# EasyEDA Pro project AgOopenHardwareMicro.eprj, schematic AiO v4 Micro Robin (continued)
## Sheets (continued)
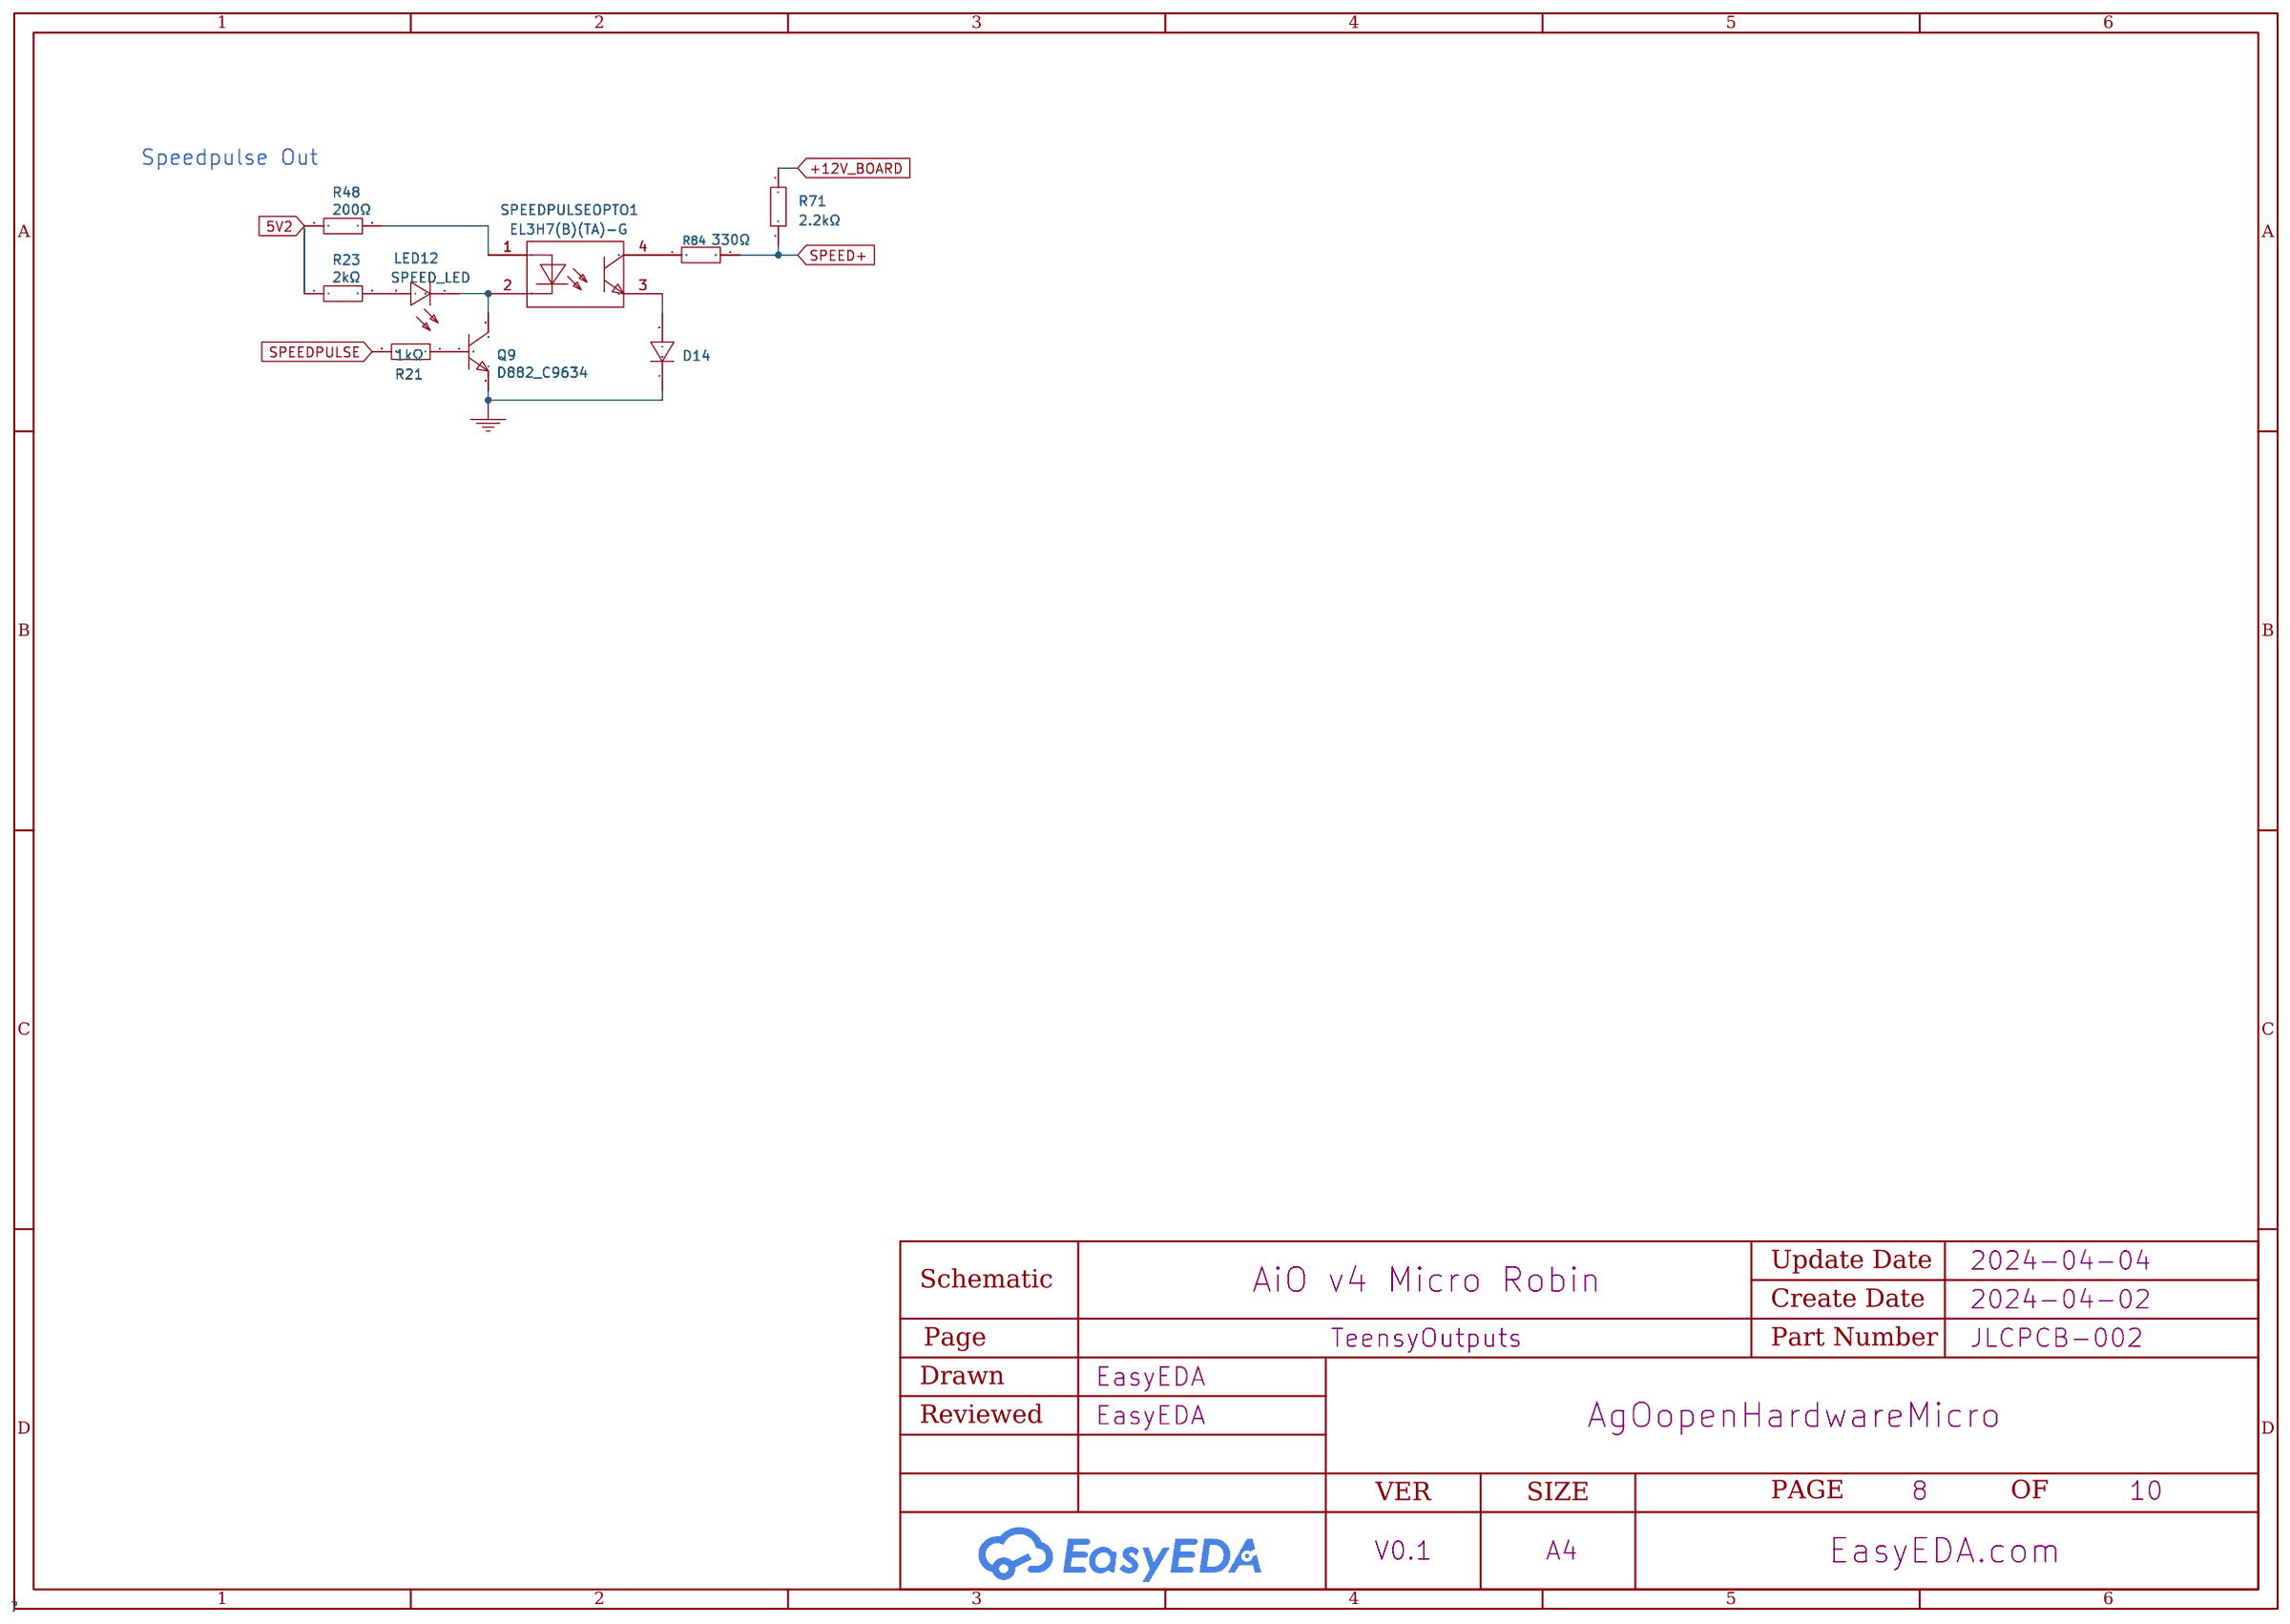
[diagram p9: TeensyOutputs]

## Parts
sheet GNSS
H1  HEADER_2mm  [footprint_0abc]
H7  HEADER_2mm  [footprint_0abc]
H9  HEADER_2mm_XBEE  [footprint_0abc]
H10  HEADER_2mm_XBEE  [footprint_0abc]
H11  HEADER_2mm  [footprint_0abc]
H12  HEADER_2mm  [footprint_0abc]
LED1  RTK_STAT_1  [footprint_1af2]  (no BOM)
LED2  RTK_STAT_2  [footprint_1af2]  (no BOM)
LED3  RTK  [footprint_6589]
LED5  RTK  [footprint_6589]
LED15  0603_RED  [footprint_985f]
LED16  0603_RED  [footprint_985f]
P2  RTK Radio  [footprint_4317]  (no BOM)
R6  1kΩ  [footprint_4e14]
R8  1k  [footprint_b4b1]  (no BOM)
R19  1kΩ  [footprint_4e14]
R26  1kΩ  [footprint_4e14]
R31  1k  [footprint_b4b1]  (no BOM)
R54  1kΩ  [footprint_4e14]
SJ2  PH2.54-01-03PZD  [HDR-TH_3P-P2.54-V-M]
U11  Dual-Left  [footprint_247a]  (no BOM)
U18  Single/Dual-Right  [footprint_3ab3]  (no BOM)
U21  LR_RADIO_XBEE_SOCKET  [footprint_2c55]  (no BOM)
USB2  MICRO 180°JB  [footprint_5333]
USB3  MICRO 180°JB  [footprint_5333]
sheet IMU
H13  HEADER_6PINS  [footprint_c888]
H14  HEADER_6PINS  [footprint_c888]
R12  2.2kΩ  [footprint_dc35]  (no BOM)
R13  2.2kΩ  [footprint_dc35]  (no BOM)
U15  Ardfruit BNO085  [footprint_7c61]  (no BOM)
sheet Power
C5  22uF  [footprint_a80e]  (no BOM)
C6  22uF  [footprint_a80e]  (no BOM)
C8  100uF  [footprint_7bcb]
C9  100uF  [footprint_7bcb]
C10  100uF  [footprint_7bcb]
C14  22uF  [footprint_a80e]  (no BOM)
C15  1000uF  [footprint_6613]
C17  1000uF  [footprint_6613]
CN3  DB128V-5.08-6P-GN-S  [CONN-TH_6P-P5.08_DIBO_DB128V-5.08]
D2  1N5401  [footprint_8dbb]  (no BOM)
D3  1N4004  [footprint_00b7]  (no BOM)
D6  SS54_C22452  [footprint_14cd]
D7  SM4007PL  [footprint_5765]
D13  SM4007PL  [footprint_5765]
FH1  178.6764.0001  [footprint_57e4]
H3  Ground  [footprint_dfc0]  (no BOM)
H24  5V  [footprint_dfc0]  (no BOM)
J3  3V3  [footprint_4a10]  (no BOM)
LED4  5V  [footprint_6589]
LED7  5V WAS  [footprint_6589]
LED8  3V3  [footprint_6589]
LED17  0603_RED  [footprint_985f]
R10  1kΩ  [footprint_4e14]
R17  5.1kΩ  [footprint_76e4]
R18  1kΩ  [footprint_4e14]
R61  5.1kΩ  [footprint_76e4]
U3  K7803M-1000R3  [footprint_a0e4]
U5  Teensy/IMU Power  [footprint_8be4]
U6  MC7805CTG  [footprint_f649]
U31  MTP125-1102S1  [HDR-TH_2P-P2.54-V-M-1]
sheet Teensy
C12  0.1uF  [footprint_9b0b]  (no BOM)
C26  100nF  [footprint_19ac]
CN2  A2005HWV-2X3P  [footprint_9724]
D20  1N5819WS  [footprint_5976]
D41  1N5819WS  [footprint_5976]
R24  1k  [footprint_b4b1]  (no BOM)
R42  1kΩ  [footprint_4e14]
RJ1  HR913550A  [footprint_28a5]
U20  TEENSY 4.1  [footprint_e0fd]  (no BOM)
U29  H_TEENSY  [footprint_5514]
U30  H_TEENSY  [footprint_5514]
U35-VUSB1  MTP125-1102S1  [HDR-TH_2P-P2.54-V-M-1]
sheet TeensyCAN
C11  100nF_CAN  [footprint_19ac]
D5  PESD1CAN,215  [footprint_eecc]
J2  MTP125-1102S1  [HDR-TH_2P-P2.54-V-M-1]
R64  120Ω  [footprint_dc35]
U17  MCP2562-E/SN  [footprint_ae0f]
U37  DB125-2.54-3P-GN-S  [CONN-TH_DB125-2.54-3P-GN]
sheet TeensyInputs
CN5  DB128V-5.08-4P-GN-S  [CONN-TH_4P-P5.08_DIBO_DB128V-5.08]
D4  SM4007PL  [footprint_5765]
D9  SM4007PL  [footprint_5765]
D11  SM4007PL  [footprint_5765]
D42  SM4007PL  [footprint_5765]
D43  SM4007PL  [footprint_5765]
D44  SM4007PL  [footprint_5765]
D45  SM4007PL  [footprint_5765]
H25  2.54-1*3P针  [HDR-TH_3P-P2.54-V-M-1]
LED_LIFTED_UP  Remote  [footprint_6b63]
LED_REMOTE1  Remote  [footprint_6b63]
LED_SPEED_GEAR  Remote  [footprint_6b63]
LED_SPEED_RADAR  Remote  [footprint_6b63]
LED_STEER1  Steer  [footprint_6b63]
LED_WORK1  Work  [footprint_6b63]
R1  270Ω  [footprint_eb8a]
R3  270Ω  [footprint_eb8a]
R16  270Ω  [footprint_eb8a]
R20  1kΩ  [footprint_4e14]
R52  1kΩ  [footprint_4e14]
R53  1kΩ  [footprint_4e14]
R76  1kΩ  [footprint_4e14]
R77  1kΩ  [footprint_4e14]
R78  1kΩ  [footprint_4e14]
R79  1kΩ  [footprint_4e14]
R80  1kΩ  [footprint_4e14]
R81  1kΩ  [footprint_4e14]
R82  1kΩ  [footprint_4e14]
R83  1kΩ  [footprint_4e14]
REMOTEOPTO1  EL3H7(B)(TA)-G  [footprint_7a44]
REMOTEOPTO2  EL3H7(B)(TA)-G  [footprint_7a44]
REMOTEOPTO3  EL3H7(B)(TA)-G  [footprint_7a44]
REMOTEOPTO4  EL3H7(B)(TA)-G  [footprint_7a44]
REMOTEOPTO5  EL3H7(B)(TA)-G  [footprint_7a44]
SPEED_PTO  Remote  [footprint_6b63]
STEEROPTO1  EL3H7(B)(TA)-G  [footprint_7a44]
WORKOPTO1  EL3H7(B)(TA)-G  [footprint_7a44]
X38  MX128-2.54-06P-GN01-Cu-Y-A  [CONN-TH_6P-P2.54_MX128-2.54-6P]
X39  MX128-2.54-06P-GN01-Cu-Y-A  [CONN-TH_6P-P2.54_MX128-2.54-6P]
sheet TeensyOutputs
D14  SM4007PL  [footprint_5765]
LED12  SPEED_LED  [footprint_985f]
Q9  D882_C9634  [footprint_acbf]
R21  1kΩ  [footprint_4e14]
R23  2kΩ  [footprint_4e14]
R48  200Ω  [footprint_dc35]
R71  2.2kΩ  [footprint_dc35]
R84  330Ω  [R0805]
SPEEDPULSEOPTO1  EL3H7(B)(TA)-G  [footprint_7a44]
sheet TeensyStatusLED
AS-ACT1  DY-339URUYGW/SN  [footprint_04ce]
GPS/RTK1  DY-339URUYGW/SN  [footprint_04ce]
LED9  PWM2_LED  [footprint_985f]
LED10  PWM1_LED  [footprint_985f]
LED11  DIR_LED  [footprint_985f]
PWR/ETH1  DY-339URUYGW/SN  [footprint_04ce]
R27  1kΩ  [footprint_4e14]
R28  1kΩ  [footprint_4e14]
R29  1kΩ  [footprint_4e14]
R30  1kΩ  [footprint_4e14]
R38  1kΩ  [footprint_4e14]
R39  1kΩ  [footprint_4e14]
R40  1kΩ  [footprint_4e14]
R41  1kΩ  [footprint_4e14]
R51  1kΩ  [footprint_4e14]
sheet WAS
C7  10nF  [footprint_89fb]
C16  100nF  [footprint_19ac]
C23  10nF  [footprint_89fb]
CN4  DB128V-5.08-4P-GN-S  [CONN-TH_4P-P5.08_DIBO_DB128V-5.08]
D16  1N5819WS  [footprint_5a89]
D17  1N5819WS  [footprint_5a89]
H26  2.54-1*3P针  [HDR-TH_3P-P2.54-V-M-1]
Q4  2N7002  [footprint_df55]
Q5  2N7002  [footprint_df55]
R22  5.1kΩ  [footprint_76e4]
R63  5.1kΩ  [footprint_76e4]
R73  1.5kΩ  [footprint_76e4]
R74  1.5kΩ  [footprint_76e4]
U4  ADS1115IDGSR  [footprint_a15c]

## Library data of the parts
H1 H7 H11 H12 = HEADER_2mm: Supplier: LCSC; Supplier Part: C691436; Manufacturer: BOOMELE(Boom Precision Elec); Manufacturer Part: C691436; JLCPCB Part Class: Extended Part
H9 H10 = HEADER_2mm_XBEE: Supplier: LCSC; Supplier Part: C691436; Manufacturer: BOOMELE(Boom Precision Elec); Manufacturer Part: C691436; JLCPCB Part Class: Extended Part
LED1 = RTK_STAT_1: Supplier: LCSC; Manufacturer: KENTO; Manufacturer Part: LEDOrange orange 3AO4UD; image: //image.lceda.cn/szlcsc/C62095.jpg; Supplier Part: C62095
LED2 = RTK_STAT_2: Supplier: LCSC; Manufacturer: KENTO; Manufacturer Part: LEDOrange orange 3AO4UD; image: //image.lceda.cn/szlcsc/C62095.jpg; Supplier Part: C62095
LED3 LED5 = RTK: Supplier: LCSC; Manufacturer: KENTO; Manufacturer Part: KT-0805翠绿; Supplier Part: C2297; JLCPCB Part Class: Basic Part
LED15-LED17 = 0603_RED: Supplier: LCSC; Manufacturer: null; Manufacturer Part: KT-0603R; Supplier Part: C2286; JLCPCB Part Class: Basic Part
P2 = RTK Radio: Supplier Part: C27542; Supplier: LCSC; Manufacturer: ReliaPro; Manufacturer Part: KF2510-4A; JLCPCB Part Class: Extended Part
R6 R10 R18-R21 R26-R30 R38-R42 R51-R54 R76-R83 = 1kΩ: Supplier: LCSC; Manufacturer: UNI-ROYAL(厚声); Manufacturer Part: 0603WAF1001T5E; Supplier Part: C21190; JLCPCB Part Class: Basic Part; link: https://lcsc.com/eda_search?q=C21190&amp;%26type=1&amp;ref=editor
R8 R24 R31 = 1k: Supplier: LCSC; Supplier Part: C433798; Manufacturer: TyoHM; Manufacturer Part: RD 1/2WS 1K J T/B A1
SJ2 = PH2.54-01-03PZD: Pin Structure:1x3P Pitch:2.54mm Circluar Pins/Square Pins:Square Pins Mounting Type:Straight Number of Rows:Plugin Number of Pins:3P Length of Mating Pin:6mm Insulation Height:2.5mm Length of End Connection Pin:3mm Contact Material: Operating Temperature; LCSC Part Name: 1x3P 间距:2.54mm 方针 直插; Supplier Part: C7501581; Manufacturer: XUNPU(讯普); Supplier Footprint: 插件,P=2.54mm; JLCPCB Part Class: Extended Part; Datasheet: https://atta.szlcsc.com/upload/public/pdf/source/20230815/30A24B1E4B9BDE2239C7F8E56770F33B.pdf; Supplier: LCSC; Pin Structure: 1x3P; Pitch: 2.54mm; Circluar Pins/Square Pins: Square Pins; Mounting Type: Straight; Number of Rows: Plugin; Number of Pins: 3P; Length of Mating Pin: 6mm; Insulation Height: 2.5mm; Length of End Connection Pin: 3mm; Operating Temperature Range: -40℃~+105℃; Color: Black
U11 = Dual-Left: Supplier: Ardusimple
U18 = Single/Dual-Right: Supplier: Ardusimple
U21 = LR_RADIO_XBEE_SOCKET
USB2 USB3 = MICRO 180°JB: Supplier: LCSC; Supplier Part: C456007; Manufacturer: SHOU HAN(首韩); JLCPCB Part Class: Extended Part
H13 H14 = HEADER_6PINS: Supplier: LCSC; Supplier Part: C2897369; Manufacturer: HCTL(华灿天禄); Manufacturer Part: PM254-1-06-Z-8.5; JLCPCB Part Class: Extended Part
R12 R13 R71 = 2.2kΩ: Supplier: LCSC; Manufacturer: UniOhm; Manufacturer Part: 0805W8F2201T5E; Supplier Part: C17520; Resistance: 2.2K; JLCPCB Part Class: Basic Part
U15 = Ardfruit BNO085: Manufacturer: Ardfruit
C5 C6 = 22uF: Supplier: LCSC; Manufacturer: ValuePro; Manufacturer Part: 22uF 16V 4*7; Supplier Part: C43845; JLCPCB Part Class: Extended Part
C8-C10 = 100uF: Supplier: LCSC; Manufacturer: Kyocera AVX; Manufacturer Part: TAJB107K006RNJ; Supplier Part: C16133; JLCPCB Part Class: Basic Part
C14 = 22uF: Supplier: LCSC; Manufacturer: ValuePro; Manufacturer Part: 22uF 16V 4*5; Supplier Part: C43800; JLCPCB Part Class: Extended Part
C15 C17 = 1000uF: Supplier: LCSC; Manufacturer: rubycon(红宝石); Manufacturer Part: 35YXJ1000M12.5X20; Supplier Part: C88743; JLCPCB Part Class: Extended Part
CN3 = DB128V-5.08-6P-GN-S: Structure:1x6P Pitch:5.08mm Color:Green Mounting Style:Straight Current Rating (Max):20A Voltage Rating (Max):300V Number of Pins:6P Number of Rows:1 Wire Gauge - AWG:12~30 Wire Gauge - AWG:12~30 Wire Gauge - mm2:2.5 Wire Gauge - mm2:2.5 Number of PINs Pe; LCSC Part Name: 5.08mm 1x6P 排数:1 每排P数:6 直插; Supplier Part: C2915642; Manufacturer: DORABO(地博电气); Supplier Footprint: 插件,P=5.08mm; JLCPCB Part Class: Extended Part; Datasheet: https://atta.szlcsc.com/upload/public/pdf/source/20230106/CC449C10514519CDCE20F1C37DBF2DAC.pdf; Supplier: LCSC; Structure: 1x6P; Pitch: 5.08mm; Color: Green; Mounting Style: Straight; Current Rating (Max): 20A; Voltage Rating (Max): 300V; Number of Pins: 6P; Number of Rows: 1; Wire Gauge - AWG: 12~30; Wire Gauge - mm2: 2.5; Number of PINs Per Row: 6; Operating Temperature Range: -40℃~+105℃
D2 = 1N5401: Supplier: LCSC; Manufacturer: MDD; image: //image.lceda.cn/szlcsc/C2459.jpg; Supplier Part: C2459; JLCPCB Part Class: Extend
D3 = 1N4004: Supplier: LCSC; Manufacturer: MDD; image: //image.lceda.cn/szlcsc/C3058.jpg; Supplier Part: C3058; JLCPCB Part Class: Extend
D6 = SS54_C22452: Supplier: LCSC; Manufacturer Part: SS54; Manufacturer: MDD; Supplier Part: C22452; JLCPCB Part Class: Basic Part
D4 D7 D9 D11 D13 D14 D42-D45 = SM4007PL: Supplier: LCSC; Manufacturer: MDD; Supplier Part: C64898; JLCPCB Part Class: Basic Part; link: https://lcsc.com/eda_search?q=C64898&amp;%26type=1&amp;ref=editor
FH1 = 178.6764.0001: Supplier: LCSC; Supplier Part: C142933; Manufacturer: Littelfuse(美国力特); JLCPCB Part Class: Extended Part
H3 = Ground: Supplier: LCSC; Manufacturer: BOOMELE; Manufacturer Part: Header-Male-2.54_1x6; Supplier Part: C37208; JLCPCB Part Class: Extended Part
H24 = 5V: Supplier: LCSC; Manufacturer: BOOMELE; Manufacturer Part: Header-Male-2.54_1x6; Supplier Part: C37208; JLCPCB Part Class: Extended Part
J3 = 3V3: Supplier Part: C124375; Supplier: LCSC
LED4 = 5V: Supplier: LCSC; Manufacturer: KENTO; Manufacturer Part: KT-0805翠绿; Supplier Part: C2297; JLCPCB Part Class: Basic Part
LED7 = 5V WAS: Supplier: LCSC; Manufacturer: KENTO; Manufacturer Part: KT-0805翠绿; Supplier Part: C2297; JLCPCB Part Class: Basic Part
LED8 = 3V3: Supplier: LCSC; Manufacturer: KENTO; Manufacturer Part: KT-0805翠绿; Supplier Part: C2297; JLCPCB Part Class: Basic Part
R17 R22 R61 R63 = 5.1kΩ: Supplier: LCSC; Manufacturer Part: 0603WAF5101T5E; Manufacturer: UniOhm; Supplier Part: C23186; Resistance: 5.1K; JLCPCB Part Class: Basic Part
U3 = K7803M-1000R3: Supplier: LCSC; Manufacturer: MORNSUN(金升阳); Supplier Part: C132363; JLCPCB Part Class: Extended Part
U5 = Teensy/IMU Power: Supplier: LCSC; Manufacturer: MORNSUN; Manufacturer Part: K7805M-1000R3; Supplier Part: C132362; JLCPCB Part Class: Extended Part
U6 = MC7805CTG: Supplier: LCSC; Manufacturer: ON; Supplier Part: C22456; JLCPCB Part Class: Extended Part
J2 U31 U35-VUSB1 = MTP125-1102S1: Pin Structure:1x2P Pitch:2.54mm Row Spacing:- Circluar Pins/Square Pins:Square Pins Mounting Type:Straight Number of Rows:Plugin Number of Pins:2P Current Rating (Max):- Voltage Rating (Max):- Length of Mating Pin:6mm Insulation Height:2.5mm Length of End; LCSC Part Name: 间距:2.54mm 1x2P 直插 方针; Supplier Part: C358684; Manufacturer: MINTRON(明硕); Supplier Footprint: 插件,P=2.54mm; JLCPCB Part Class: Extended Part; Datasheet: https://atta.szlcsc.com/upload/public/pdf/source/20190124/C358691_14EEE47B6F852A185E1BED738B24D535.pdf; Supplier: LCSC; Pin Structure: 1x2P; Pitch: 2.54mm; Circluar Pins/Square Pins: Square Pins; Mounting Type: Straight; Number of Rows: Plugin; Number of Pins: 2P; Length of Mating Pin: 6mm; Insulation Height: 2.5mm; Length of End Connection Pin: 3mm; Operating Temperature Range: -40℃~+105℃; Color: Black
C12 = 0.1uF: Supplier: LCSC; Supplier Part: C444736; Manufacturer: AVX; Manufacturer Part: SR155C103KAR; JLCPCB Part Class: Extend
C16 C26 = 100nF: Supplier: LCSC; Manufacturer: YAGEO; Manufacturer Part: CC0603KRX7R9BB104; Supplier Part: C14663; JLCPCB Part Class: Basic Part
CN2 = A2005HWV-2X3P: Supplier: LCSC; Supplier Part: C2906071; JLCPCB Part Class: Extended Part
D16 D17 D20 D41 = 1N5819WS: Supplier: LCSC; Supplier Part: C191023; Manufacturer: Hottech(合科泰); JLCPCB Part Class: Basic Part; link: https://lcsc.com/eda_search?q=C191023&amp;%26type=1&amp;ref=editor
RJ1 = HR913550A: Supplier: LCSC; Manufacturer: HANRUN; Supplier Part: C163507; JLCPCB Part Class: Extended Part
U20 = TEENSY 4.1: Manufacturer: PJRC; Manufacturer Part: TEENSY41; Supplier: PJRC; Supplier Part: TEENSY41; link: https://www.pjrc.com/store/teensy41.html
U29 U30 = H_TEENSY: Supplier: LCSC; Supplier Part: C2883741; Manufacturer: XKB Connectivity(中国星坤); Manufacturer Part: X6511FV-24-C85D32; JLCPCB Part Class: Extended Part
C11 = 100nF_CAN: Supplier: LCSC; Manufacturer: YAGEO; Manufacturer Part: CC0603KRX7R9BB104; Supplier Part: C14663; JLCPCB Part Class: Basic Part
D5 = PESD1CAN,215: Supplier: LCSC; Manufacturer: Nexperia; image: //image.lceda.cn/szlcsc/C15771.jpg; Supplier Part: C15771; JLCPCB Part Class: Extend; JLCPCB SMD: Yes; Paste Type: expand
R64 = 120Ω: Supplier: LCSC; Manufacturer: UniOhm; Manufacturer Part: 0805W8F1200T5E; Supplier Part: C17437; Resistance: 120; JLCPCB Part Class: Basic Part
U17 = MCP2562-E/SN: Supplier: LCSC; Manufacturer: MICROCHIP; Supplier Part: C53609; JLCPCB Part Class: Extended Part
U37 = DB125-2.54-3P-GN-S: Structure:1x3P Pitch:2.54mm Color:- Mounting Style:Straight Current Rating (Max):8A Voltage Rating (Max):130V Number of Pins:3P Number of Rows:1 Wire Gauge - AWG:18~26 Wire Gauge - AWG:18~26 Wire Gauge - mm2:0.5~1 Wire Gauge - mm2:0.5~1 Number of PINs Per; LCSC Part Name: 2.54mm 1x3P 排数:1 每排P数:3 直插; Supplier Part: C918121; Manufacturer: DORABO(地博电气); Supplier Footprint: 插件,P=2.54mm; JLCPCB Part Class: Extended Part; Datasheet: https://atta.szlcsc.com/upload/public/pdf/source/20230106/BCD3A0BE1EB95DC3E813F1745F022035.pdf; Supplier: LCSC; Structure: 1x3P; Pitch: 2.54mm; Mounting Style: Straight; Current Rating (Max): 8A; Voltage Rating (Max): 130V; Number of Pins: 3P; Number of Rows: 1; Wire Gauge - AWG: 18~26; Wire Gauge - mm2: 0.5~1; Number of PINs Per Row: 3; Operating Temperature Range: -40℃~+105℃
CN4 CN5 = DB128V-5.08-4P-GN-S: Structure:1x4P Pitch:5.08mm Color:Green Mounting Style:Straight Current Rating (Max):20A Voltage Rating (Max):300V Number of Pins:4P Number of Rows:1 Wire Gauge - AWG:12~30 Wire Gauge - AWG:12~30 Wire Gauge - mm2:2.5 Wire Gauge - mm2:2.5 Number of PINs Pe; LCSC Part Name: 5.08mm 1x4P 排数:1 每排P数:4 直插; Supplier Part: C2915641; Manufacturer: DORABO(地博电气); Supplier Footprint: 插件,P=5.08mm; JLCPCB Part Class: Extended Part; Datasheet: https://atta.szlcsc.com/upload/public/pdf/source/20230106/CC449C10514519CDCE20F1C37DBF2DAC.pdf; Supplier: LCSC; Structure: 1x4P; Pitch: 5.08mm; Color: Green; Mounting Style: Straight; Current Rating (Max): 20A; Voltage Rating (Max): 300V; Number of Pins: 4P; Number of Rows: 1; Wire Gauge - AWG: 12~30; Wire Gauge - mm2: 2.5; Number of PINs Per Row: 4; Operating Temperature Range: -40℃~+105℃
H25 H26 = 2.54-1*3P针: Pin Structure:1x3P Pitch:2.54mm Row Spacing:- Circluar Pins/Square Pins:Square Pins Mounting Type:Straight Number of Rows:Plugin Number of Pins:3P Current Rating (Max):3A Voltage Rating (Max):- Length of Mating Pin:- Insulation Height:- Length of End Conn; LCSC Part Name: 间距:2.54mm 1x3P 直插 方针; Supplier Part: C49257; Manufacturer: BOOMELE(博穆精密); Supplier Footprint: 插件,P=2.54mm; JLCPCB Part Class: Extended Part; Datasheet: https://atta.szlcsc.com/upload/public/pdf/source/20221018/3E9408392E35E6F57A28985E5F7BF5C9.pdf; Supplier: LCSC; Pin Structure: 1x3P; Pitch: 2.54mm; Circluar Pins/Square Pins: Square Pins; Mounting Type: Straight; Number of Rows: Plugin; Number of Pins: 3P; Current Rating (Max): 3A; Operating Temperature Range: -40℃~+105℃; Color: Black
LED_LIFTED_UP LED_REMOTE1 LED_SPEED_GEAR LED_SPEED_RADAR SPEED_PTO = Remote: Supplier: LCSC; Manufacturer: null; Manufacturer Part: KT-0603白灯; Supplier Part: C2290; JLCPCB Part Class: Basic Part
LED_STEER1 = Steer: Supplier: LCSC; Manufacturer: null; Manufacturer Part: KT-0603白灯; Supplier Part: C2290; JLCPCB Part Class: Basic Part
LED_WORK1 = Work: Supplier: LCSC; Manufacturer: null; Manufacturer Part: KT-0603白灯; Supplier Part: C2290; JLCPCB Part Class: Basic Part
R1 R3 R16 = 270Ω: Supplier: LCSC; Manufacturer: UNI-ROYAL(厚声); Manufacturer Part: 0603WAF2700T5E; Supplier Part: C22966; Resistance: 270; JLCPCB Part Class: Basic Part
REMOTEOPTO1-REMOTEOPTO5 SPEEDPULSEOPTO1 STEEROPTO1 WORKOPTO1 = EL3H7(B)(TA)-G: Supplier: LCSC; Manufacturer: EVERLIGHT(亿光); Supplier Part: C32565; JLCPCB Part Class: Basic Part
X38 X39 = MX128-2.54-06P-GN01-Cu-Y-A: Structure:1x6P Pitch:2.54mm Color:Green Mounting Style:Straight Current Rating (Max):6A Voltage Rating (Max):150V Number of Pins:6P Number of Rows:1 Wire Gauge - AWG:18~24 Wire Gauge - AWG:18~24 Wire Gauge - mm2:1 Wire Gauge - mm2:1 Number of PINs Per Row; LCSC Part Name: 2.54mm 1x6P 排数:1 每排P数:6 直插; Supplier Part: C5188446; Manufacturer: MAX(迈旭); Supplier Footprint: 插件,P=2.54mm; JLCPCB Part Class: Extended Part; Datasheet: https://atta.szlcsc.com/upload/public/pdf/source/20230914/7C75AD31AD41EB9EF855A76DB002C0D2.pdf; Supplier: LCSC; Structure: 1x6P; Pitch: 2.54mm; Color: Green; Mounting Style: Straight; Current Rating (Max): 6A; Voltage Rating (Max): 150V; Number of Pins: 6P; Number of Rows: 1; Wire Gauge - AWG: 18~24; Wire Gauge - mm2: 1; Number of PINs Per Row: 6; Contact Material: Copper Alloy; Contact Plating: Tin; Operating Temperature Range: -40℃~+105℃
LED12 = SPEED_LED: Supplier: LCSC; Manufacturer: EVERLIGHT(亿光); Manufacturer Part: 19-213/Y2C-CQ2R2L/3T(CY); Supplier Part: C72038; JLCPCB Part Class: Basic Part
Q9 = D882_C9634: Supplier: LCSC; Manufacturer: CJ(江苏长电/长晶); Manufacturer Part: D882 Y档160~320; Supplier Part: C9634; JLCPCB Part Class: Basic Part; link: https://lcsc.com/eda_search?q=C9634&amp;%26type=1&amp;ref=editor
R23 = 2kΩ: Supplier: LCSC; Manufacturer: UNI-ROYAL(厚声); Manufacturer Part: 0603WAF2001T5E; Supplier Part: C22975; JLCPCB Part Class: Basic Part; link: https://lcsc.com/eda_search?q=C22975&amp;%26type=1&amp;ref=editor
R48 = 200Ω: Supplier: LCSC; Manufacturer: UNI-ROYAL(厚声); Manufacturer Part: 0805W8F2000T5E; Supplier Part: C17540; Resistance: 200; JLCPCB Part Class: Basic Part
R84 = 0805W8F3300T5E: Type:Thick Film Resistors Resistance: Tolerance:±1% Tolerance:±1% Power(Watts): Overload Voltage (Max): Temperature Coefficient:±100ppm/℃ Temperature Coefficient:±100ppm/℃ Operating Temperature Range:-55℃~+155℃ Operating Temperature Range:-55℃~+155℃; LCSC Part Name: 330Ω ±1% 125mW 厚膜电阻; Supplier Part: C17630; Manufacturer: UNI-ROYAL(厚声); Supplier Footprint: 0805; JLCPCB Part Class: Basic Part; Datasheet: https://atta.szlcsc.com/upload/public/pdf/source/20200306/C422600_1E6D84923E4A46A82E41ADD87F860B5C.pdf; Supplier: LCSC; Type: Thick Film Resistors; Tolerance: ±1%; Temperature Coefficient: ±100ppm/℃; Operating Temperature Range: -55℃~+155℃
AS-ACT1 GPS/RTK1 PWR/ETH1 = DY-339URUYGW/SN: Supplier: LCSC; Supplier Part: C459134; Manufacturer: TONYU; JLCPCB Part Class: Extended Part
LED9 = PWM2_LED: Supplier: LCSC; Manufacturer: EVERLIGHT(亿光); Manufacturer Part: 19-213/Y2C-CQ2R2L/3T(CY); Supplier Part: C72038; JLCPCB Part Class: Basic Part
LED10 = PWM1_LED: Supplier: LCSC; Manufacturer: EVERLIGHT(亿光); Manufacturer Part: 19-213/Y2C-CQ2R2L/3T(CY); Supplier Part: C72038; JLCPCB Part Class: Basic Part
LED11 = DIR_LED: Supplier: LCSC; Manufacturer: EVERLIGHT(亿光); Manufacturer Part: 19-213/Y2C-CQ2R2L/3T(CY); Supplier Part: C72038; JLCPCB Part Class: Basic Part
C7 C23 = 10nF: Supplier: LCSC; Manufacturer Part: CL21B103KBANNNC; Manufacturer: SAMSUNG; Supplier Part: C1710; JLCPCB Part Class: Basic Part
Q4 Q5 = 2N7002: Supplier: LCSC; Manufacturer: CJ; Supplier Part: C8545; JLCPCB Part Class: Basic Part
R73 R74 = 1.5kΩ: Supplier: LCSC; Manufacturer: UniOhm; Manufacturer Part: 0603WAF1501T5E; Supplier Part: C22843; Resistance: 1.5K; JLCPCB Part Class: Basic Part
U4 = ADS1115IDGSR: Supplier: LCSC; Manufacturer: TI; Supplier Part: C37593; JLCPCB Part Class: Extended Part

## Nets
3.3V: H14.1 Q4.1(G) Q5.1(G) R12.2 R13.2 R20.2 R24.2 R42.2 R52.2 R53.2 R76.2 R78.2 R80.2 R82.2 U15.1(Vin) U17.5(VIO) U29.15 U30.3
3V3: C8.1 C14.1 H1.1 H9.1 H11.1 J3.1 J3.2 LED3.1(A) LED5.1(A) P2.4 R10.2 U3.3(+Vo) U11.1(VCC) U18.1(VCC) U21.1(VCC)
5V2: C6.1 C9.1 C11.2 D20.2(A) H24.1 H24.2 H24.3 H24.4 H24.5 H24.6 P2.1 R1.2 R3.2 R16.2 R23.1 R48.1 R61.1 U5.3(+VO) U17.3(VDD)
5V_USB: H11.6 U18.6(PWM0RSSI) USB2.1(VCC)
5V_USB_1: H1.6 U11.6(PWM0RSSI) USB3.1(VCC)
5V_WAS: C5.1 C10.1 C16.1 CN4.1 D16.1(K) D17.1(K) R17.2 R22.1 R63.1 U4.8(VDD) U6.3(Output)
+12V_BOARD: C15.1 C17.1 D2.1(C) D3.2(K) D6.2(K) D7.1(C) R71.2 U3.1(Vin) U5.1(VIN) U6.1(Input) U31.1
+12V_IN: CN3.1 CN3.2 CN3.3 FH1.1
GND: AS-ACT1.2(-) C5.2 C6.2 C7.1 C8.2 C9.2 C10.2 C11.1 C12.1 C14.2 C15.2 C16.2 C17.2 C23.1 C26.1 CN2.4 CN3.4 CN3.5 CN3.6 CN4.4 CN5.4 D3.1(A) D5.3 D7.2(A) D14.1(C) GPS/RTK1.2(-) H1.10 H3.1 H3.2 H3.3 H3.4 H3.5 H3.6 H7.10 H9.10 H11.10 H12.10 H14.3 H26.1 LED1.2(K) LED2.2(K) LED4.2(K) LED7.2(K) LED8.2(K) LED9.1(C) LED10.1(C) LED11.1(C) LED15.1(K) LED16.1(K) LED17.2(A) P2.2 PWR/ETH1.2(-) Q9.3(E) REMOTEOPTO1.3(EM) REMOTEOPTO2.3(EM) REMOTEOPTO3.3(EM) REMOTEOPTO4.3(EM) REMOTEOPTO5.3(EM) RJ1.8(GND) RJ1.10 RJ1.11 RJ1.13 RJ1.14 STEEROPTO1.3(EM) U3.2(GND) U4.3(GND) U5.2(GND) U6.2(Ground) U11.10(GND) U11.11(EN) U15.3(GND) U17.2(VSS) U17.8(STBY) U18.10(GND) U18.11(EN) U21.10(GND) U29.1 U30.2 U30.15 U31.2 U35-VUSB1.2 U37.1 USB2.5(GND) USB2.6(EH) USB3.5(GND) USB3.6(EH) WORKOPTO1.3(EM)
GND_X38: REMOTEOPTO2.2(CAT) REMOTEOPTO3.2(CAT) REMOTEOPTO4.2(CAT) REMOTEOPTO5.2(CAT) X38.6 X39.6
VIN: D20.1(K) D41.1(K) U30.1
AS_ACT: R39.2 U29.14
AS_STB: R38.2 U29.13
CAN_H: D5.2 R64.2 U17.7(CANH) U37.2
CAN_L: D5.1 J2.1 U17.6(CANL) U37.3
CANRX1: U17.4(RXD) U29.22
CANTX1: U17.1(TXD) U29.23
DATA_+: H11.7 U18.7(PWM1) USB2.3(D+)
DATA_+_1: H1.7 U11.7(PWM1) USB3.3(D+)
DATA_-: H11.8 U18.8(RESERVED) USB2.2(D-)
DATA_-_1: H1.8 U11.8(RESERVED) USB3.2(D-)
DIR: R51.2 U29.6
ETH_LED: CN2.3 RJ1.12
ETHERNET: R30.2 U29.8
F9P: H12.5 SJ2.3 U18.16(RTSAD6DIO6)
GPSFIX: R40.2 U29.11
HEIGTH: X38.5 X39.5
LIFTED: D45.2(A) X38.4 X39.4
LIFTED_TEENSY: LED_LIFTED_UP.2(K) REMOTEOPTO5.4(COL) U29.19
POWERON: R29.2 U29.7
PWM1: R28.2 U29.4
PWM2: R27.2 U29.5
R+: CN2.1 RJ1.3
R-: CN2.2 RJ1.6
REMOTEPIN: CN5.3 D9.1(C)
REMOTETEENSY: LED_REMOTE1.2(K) REMOTEOPTO1.4(COL) U30.20
RTKFIX: R41.2 U29.12
RX1: H11.2 U18.2(TX) U29.20
RX2: H1.2 U11.2(TX) U29.9
RX3: H9.2 P2.3 SJ2.1 SJ2.2 U21.2(TX) U30.12
SCL0: H14.4 R13.1 U15.4(SCL) U30.8
SCL_HV: Q4.3(D) R63.2 U4.10(SCL)
SCL_LV: Q4.2(S) U30.11
SDA0: H14.5 R12.1 U15.5(SDA) U30.9
SDA_HV: Q5.3(D) R22.2 U4.9(SDA)
SDA_LV: Q5.2(S) U30.10
SPEED+: H25.3 R71.1 R84.2
SPEED_GEAR: D43.2(A) X38.2 X39.2
SPEED_GEAR_TEENSY: LED_SPEED_GEAR.2(K) REMOTEOPTO3.4(COL) U30.22
SPEED_PTO: D44.2(A) X38.3 X39.3
SPEED_PTO_TEENSY: REMOTEOPTO4.4(COL) SPEED_PTO.2(K) U30.19
SPEED_RADAR: H25.2 X39.1
SPEED_RADAR_TEENSY: LED_SPEED_RADAR.2(K) REMOTEOPTO2.4(COL) U30.24
SPEEDPULSE: R21.2 U30.21
STEERPIN: CN5.1 D4.1(C)
STEERTEENSY: LED_STEER1.2(K) STEEROPTO1.4(COL) U29.24
T+: CN2.6 RJ1.1
T-: CN2.5 RJ1.2
T_VUSB: D41.2(A) U35-VUSB1.1
TX1: H11.3 U18.3(RX) U29.21
TX2: H1.3 U11.3(RX) U29.10
WAS_H: CN4.2 R74.2
WAS_L: CN4.3 R73.2
WORKPIN: CN5.2 D11.1(C)
WORKTEENSY: LED_WORK1.2(K) U30.23 WORKOPTO1.4(COL)
$2N868: LED17.1(K) R18.1
$2N869: D13.2(A) R18.2
$2N2134: LED4.1(A) R61.2
$2N4039: LED7.1(A) R17.1
$2N4060: LED8.1(A) R10.1
$3N834: C7.2 D16.2(A) R73.1 U4.5(AIN1)
$3N857: C23.2 D17.2(A) R74.1 U4.4(AIN0)
$3N1928: H26.2 U4.6(AIN2)
$3N1938: H26.3 U4.7(AIN3)
$4N682: R16.1 WORKOPTO1.1(AN)
$4N683: R1.1 STEEROPTO1.1(AN)
$4N684: R3.1 REMOTEOPTO1.1(AN)
$4N688: LED_WORK1.1(A) R52.1
$4N689: LED_STEER1.1(A) R53.1
$4N690: LED_REMOTE1.1(A) R20.1
$4N1067: D11.2(A) WORKOPTO1.2(CAT)
$4N1069: D9.2(A) REMOTEOPTO1.2(CAT)
$4N1248: LED_SPEED_RADAR.1(A) R76.1
$4N1557: R77.2 REMOTEOPTO2.1(AN)
$4N1559: D42.1(C) R77.1
$4N1719: LED_SPEED_GEAR.1(A) R78.1
$4N1720: R79.2 REMOTEOPTO3.1(AN)
$4N1722: D43.1(C) R79.1
$4N1885: R80.1 SPEED_PTO.1(A)
$4N1886: R81.2 REMOTEOPTO4.1(AN)
$4N1888: D44.1(C) R81.1
$4N2051: LED_LIFTED_UP.1(A) R82.1
$4N2052: R83.2 REMOTEOPTO5.1(AN)
$4N2054: D45.1(C) R83.1
$4N2393: D42.2(A) H25.1 X38.1
$4N2442: D4.2(A) STEEROPTO1.2(CAT)
$6N225: LED11.2(A) R51.1
$6N226: LED10.2(A) R28.1
$6N227: LED9.2(A) R27.1
$6N647: GPS/RTK1.1(+) R41.1
$6N649: GPS/RTK1.3(+) R40.1
$6N651: AS-ACT1.1(+) R39.1
$6N653: AS-ACT1.3(+) R38.1
$6N656: PWR/ETH1.1(+) R30.1
$6N657: PWR/ETH1.3(+) R29.1
$7N1900: H14.6 U15.6(INT)
$7N1905: H14.2 U15.2(3v3)
$7N1907: H13.1 U15.7(CS)
$7N1923: H13.2 U15.8(DI)
$7N1925: H13.3 U15.9(RST)
$7N1927: H13.4 U15.10(P1)
$7N2002: H13.5 U15.11(P0)
$7N2003: H13.6 U15.12(BT)
$8N1397: H7.5 H12.9 U11.16(RTSAD6DIO6) U18.12(CTSDIO7)
$8N1403: H1.4 U11.4(DO8)
$8N1404: H1.5 U11.5(RESET)
$8N1408: H1.9 U11.9(DTRDI8)
$8N1410: H7.1 U11.20(VDD_Ext)
$8N1411: H7.2 U11.19(RES_H)
$8N1412: H7.4 U11.17(AD3DIO3)
$8N1413: H7.6 U11.15(ASCAD5DIO5)
$8N1414: H7.7 U11.14(VREF)
$8N1415: H7.8 U11.13(ONSLEEP)
$8N1416: H7.9 U11.12(CTSDIO7)
$8N1421: H11.4 U18.4(DO8)
$8N1422: H11.5 U18.5(RESET)
$8N1426: H11.9 U18.9(DTRDI8)
$8N1428: H12.1 U18.20(VDD_Ext)
$8N1429: H12.2 U18.19(RES_H)
$8N1430: H12.4 U18.17(AD3DIO3)
$8N1431: H12.6 U18.15(ASCAD5DIO5)
$8N1432: H12.7 U18.14(VREF)
$8N1433: H12.8 U18.13(ONSLEEP)
$8N1436: H9.3 U21.3(RX)
$8N1437: H9.4 U21.4(DO8)
$8N1438: H9.5 U21.5(RESET)
$8N1439: H9.6 U21.6(PWM0RSSI)
$8N1440: H9.7 U21.7(PWM1)
$8N1441: H9.8 U21.8(RESERVED)
$8N1442: H9.9 U21.9(DTRDI8)
$8N1444: H10.1 U21.20(VDD_Ext)
$8N1445: H10.2 U21.19(RES_H)
$8N1446: H10.3 U21.18(AD2DIO2)
$8N1447: H10.4 U21.17(AD3DIO3)
$8N1448: H10.5 U21.16(RTSAD6DIO6)
$8N1449: H10.7 U21.14(VREF)
$8N1450: H10.8 U21.13(ONSLEEP)
$8N1451: H10.9 U21.12(CTSDIO7)
$8N1452: H10.10 U21.11(EN)
$8N1453: H10.6 U21.15(ASCAD5DIO5)
$8N1488: LED5.2(K) R6.2
$8N1489: LED3.2(K) R54.2
$9N252: J2.2 R64.1
$10N571: R48.2 SPEEDPULSEOPTO1.1(AN)
$10N572: LED12.1(C) Q9.2(C) SPEEDPULSEOPTO1.2(CAT)
$10N584: LED12.2(A) R23.2
$10N586: Q9.1(B) R21.1
$10N1472: R84.1 SPEEDPULSEOPTO1.4(COL)
$10N1558: D14.2(A) SPEEDPULSEOPTO1.3(EM)
Net-(C12-2): C12.2 C26.2 RJ1.4 RJ1.5
Net-(D2-2): D2.2(A) D6.1(A) D13.1(C) FH1.2
Net-(H7-3): H7.3 R19.2 R31.2 R54.1 U11.18(AD2DIO2)
Net-(H12-3): H12.3 R6.1 R8.2 R26.2 U18.18(AD2DIO2)
Net-(LED1-1): LED1.1(A) LED15.2(A) R19.1 R31.1
Net-(LED2-1): LED2.1(A) LED16.2(A) R8.1 R26.1
Net-(R24-1): R24.1 R42.1 RJ1.9

Not connected (* = marked no-connect by the designer): RJ1 7(NC)*; U4 1(ADDR)* 2(ALERT/RDY)*; U29 2* 3* 16 17* 18; U30 4* 5* 6 7 13 14* 16 17 18; USB2 4(ID)*; USB3 4(ID)*

## Notes on the sheets
sheet 1
- Power Input/Converters
sheet 2
- WAS Circuit
- Convert 5V <> 3.3V SPI interface
sheet 3
- Input Switches
sheet 4
- Ethernet
sheet 6
- IMU
sheet 7
- Left
- Right
sheet 8
- CANBUS
sheet 9
- Speedpulse Out
